# EasyEDA Pro project DartBLDC_Crtl(V2).eprj (continued)
## Notes on the sheets (continued)
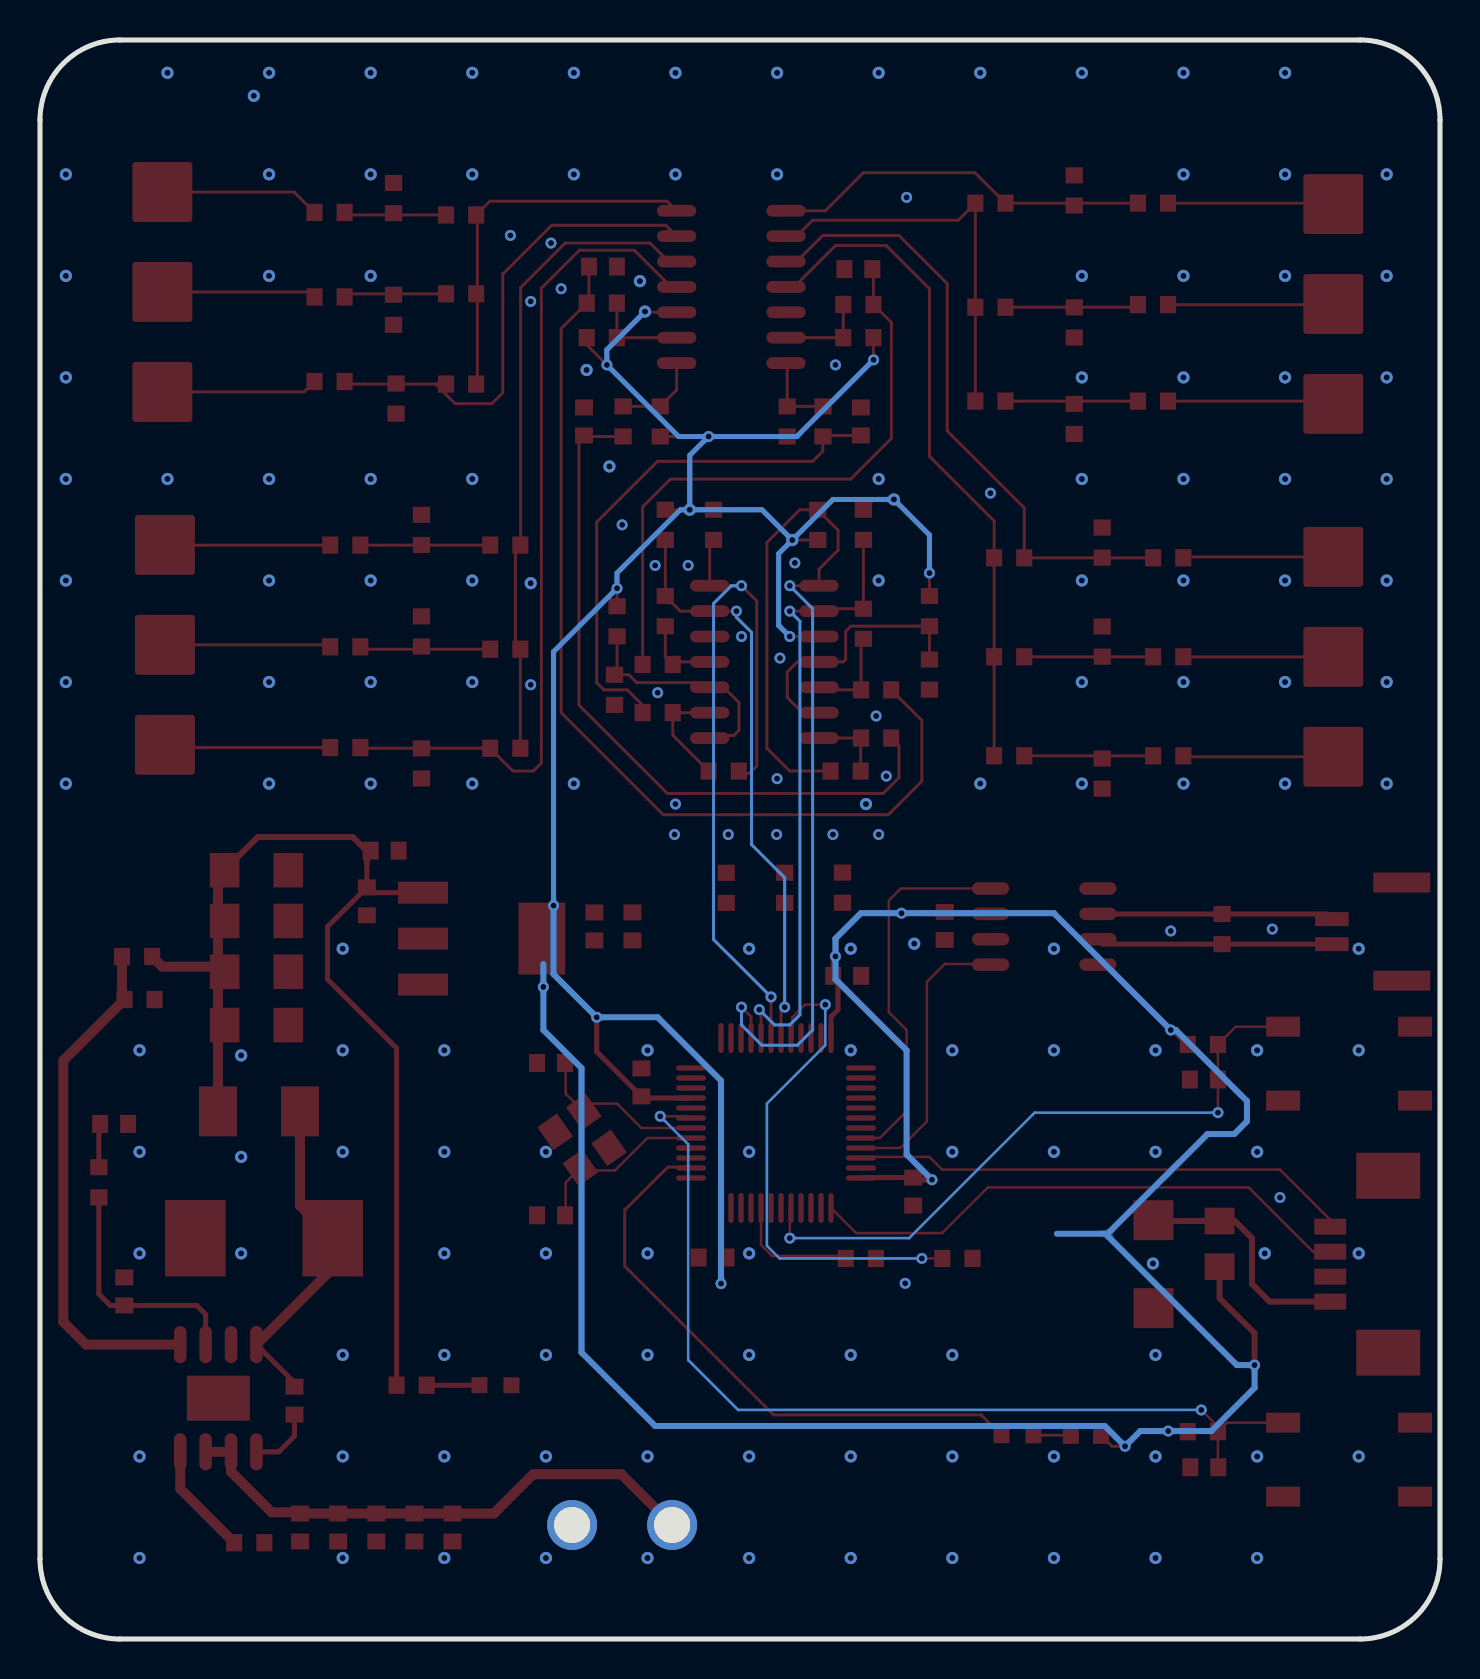
[diagram p4: board, bottom side, seen from below]

Outline 70 x 80 mm; copper layers: Top Layer, Bottom Layer. Coordinates in mm from the lower left corner of the outline.
Outline path: 0,76 0,4 arc(1.17,1.17) 4,0 66,0 arc(68.83,1.17) 70,4 70,76 arc(68.83,78.83) 66,80 4,80 arc(1.17,78.83) 0,76
Stack: Top Layer 0.035mm / Dielectric1 1.51mm FR4 er 4.5 / Bottom Layer 0.035mm

## Design rules (mm)
net OSCIN: DP1
net OSCOUT: DP1
template: 自定义配置
spacing copperThickness1oz (default): track to track 0.102, other pairs 0.152 to 0.3
spacing copperThickness2oz: track to track 0.203, other pairs 0.152 to 0.3
track width copperThickness1oz (default): min 0.127, default 0.254, max 2.54
track width copperThickness2oz: min 0.203, default 0.254, max 2.54
differential pair differentialPair (default): width min 0.127, default 0.254, max 2.54; gap min 0.152, default 0.152
via viaSize (default): diameter min 0.5, default 0.61, max 10; hole min 0.3, default 0.305, max 6.3
net GND uses copperRegion1
net GND_24V uses copperRegion1

## Placement (name value [footprint] x y rotation side)
3PHASE_INPUT1  WJ128V-5.0-3P  [CONN-TH_3P-P5.00_WJ128V-5.0-3P]  63.88 67.39 90 top
3PHASE_INPUT2  WJ128V-5.0-3P  [CONN-TH_3P-P5.00_WJ128V-5.0-3P]  63.75 49.74 90 top
3PHASE_INPUT3  WJ128V-5.0-3P  [CONN-TH_3P-P5.00_WJ128V-5.0-3P]  5.33 66.79 270 top
3PHASE_INPUT4  WJ128V-5.0-3P  [CONN-TH_3P-P5.00_WJ128V-5.0-3P]  5.33 49.14 270 top
C1  100nF  [C0603]  24.77 35.68 270 top
C2  100nF  [C0603]  11.8 27.99 0 top
C3  100nF  [C0603]  11.79 8.59 180 top
C4  22pF  [C0603]  44.45 21.2 180 top
C5  22pF  [C0603]  44.45 28.82 180 top
C6  100nF  [C0603]  36.37 19.08 180 top
C7  100nF  [C0603]  29.64 33.18 0 top
C8  100nF  [C0603]  26.34 22.39 90 top
C9  100nF  [C0603]  39.93 27.85 270 top
C10  100nF  [C0603]  28.96 60.91 270 top
C11  100nF  [C0603]  42.8 60.91 270 top
C12  100nF  [C0603]  41.85 68.66 0 top
C13  100nF  [C0603]  29.08 68.53 180 top
C14  100nF  [C0603]  57.28 11.93 270 top
C15  47uF  [C1206]  59.18 30.72 0 top
C16  47uF  [C1206]  59.18 33.38 0 top
C17  47uF  [C1206]  59.18 35.92 0 top
C18  4.7nF  [C0603]  49.38 5.58 90 top
C19  4.7nF  [C0603]  51.28 5.58 90 top
C20  4.7nF  [C0603]  53.19 5.58 90 top
C21  4.7nF  [C0603]  55.09 5.58 90 top
C22  100nF  [C0603]  57 5.58 90 top
C23  47uF  [C1206]  59.18 38.46 0 top
C24  22pF  [C0603]  65.79 17.39 270 top
C25  3.3nF  [C0603]  66.29 25.77 0 top
C26  10uF  [C0603]  40.38 35.65 270 top
C27  100nF  [C0603]  42.28 35.65 90 top
C28  100nF  [C0603]  53.66 36.9 270 top
C29  10uF  [C0603]  52.77 39.44 0 top
CN2  HC-GH-2PLT  [CONN-SMD_2P-P1.25_HCTL_HC-GH-2PLT]  3.66 35.39 270 top
CN4  XT30UPB-M  [CONN-TH_XT30UPB-M]  40.89 5.7 180 top
D1  SS34  [SMA_L4.3-W2.6-LS5.2-RD]  14.33 18.75 270 top
D2  B560C-13-F  [SMC_L7.1-W6.2-LS8.1-RD]  58.8 20.05 0 top
F1  BSMD0805-100-6V  [F0805]  11.02 19.77 90 top
KEY  -  [SW-SMD_4P-L5.1-W5.1-P3.70-LS6.5-TL-2]  4.55 28.79 0 top
L1  10uH  [IND-SMD_L5.4-W5.2]  59.05 26.4 180 top
LED1  19-213/Y2C-CQ2R2L/3T(CY)  [LED0603-RD-YELLOW]  21.13 10.19 180 top
PWR  -  [LED0603-RD]  47.23 12.7 0 top
R1  120Ω  [R0603]  10.9 35.52 270 top
R2  10kΩ  [R0603]  24.13 19.04 180 top
R3  1kΩ  [R0603]  17.7 10.19 180 top
R4  10kΩ  [R0603]  11.86 10.37 0 top
R6  10kΩ  [R0603]  11.86 29.74 0 top
R7  0Ω  [R0603]  35.69 37.58 270 top
R8  0Ω  [R0603]  32.77 37.58 270 top
R9  0Ω  [R0603]  29.87 37.59 270 top
R10  10kΩ  [R0603]  55.52 62.91 180 top
R11  1kΩ  [R0603]  48.94 62.79 180 top
R12  10kΩ  [R0603]  13.59 54.09 0 top
R13  1kΩ  [R0603]  21.54 54.09 0 top
R14  10kΩ  [R0603]  55.52 67.14 180 top
R15  1kΩ  [R0603]  48.94 67.3 180 top
R16  10kΩ  [R0603]  13.59 49.14 0 top
R17  1kΩ  [R0603]  21.54 49.14 0 top
R18  10kΩ  [R0603]  55.52 71.37 180 top
R19  1kΩ  [R0603]  48.94 71.25 180 top
R20  10kΩ  [R0603]  13.59 44.19 0 top
R21  1kΩ  [R0603]  21.54 44.19 0 top
R22  1kΩ  [R0603]  52.2 62.06 90 top
R23  1kΩ  [R0603]  52.32 66.5 90 top
R24  1kΩ  [R0603]  52.32 72.09 270 top
R25  1kΩ  [R0603]  16.89 54.85 270 top
R26  1kΩ  [R0603]  16.89 49.9 270 top
R27  1kΩ  [R0603]  16.89 43.3 90 top
R28  10kΩ  [R0603]  54.74 44.6 180 top
R29  1kΩ  [R0603]  46.74 44.57 180 top
R30  10kΩ  [R0603]  54.74 49.64 180 top
R31  1kΩ  [R0603]  46.74 49.52 180 top
R32  10kΩ  [R0603]  54.74 54.73 180 top
R33  1kΩ  [R0603]  46.74 54.73 180 top
R34  10kΩ  [R0603]  31.11 55.74 270 top
R35  10kΩ  [R0603]  28.83 55.74 90 top
R36  10kΩ  [R0603]  36.32 55.74 90 top
R37  10kΩ  [R0603]  38.73 55.74 90 top
R38  10kΩ  [R0603]  38.99 60.91 270 top
R39  10kΩ  [R0603]  41.91 65.11 0 top
R40  1kΩ  [R0603]  50.93 43.8 90 top
R41  1kΩ  [R0603]  50.93 50.41 270 top
R42  1kΩ  [R0603]  50.93 55.49 270 top
R43  470Ω  [R0603]  30.85 60.91 270 top
R44  1kΩ  [R0603]  41.15 50.92 90 top
R45  10kΩ  [R0603]  32.64 60.91 270 top
R46  10kΩ  [R0603]  29.08 65.11 180 top
R47  1kΩ  [R0603]  25.53 51.42 90 top
R48  470Ω  [R0603]  40.84 60.91 90 top
R49  10kΩ  [R0603]  28.19 47.49 0 top
R50  10kΩ  [R0603]  39.12 48.76 0 top
R51  1kΩ  [R0603]  41.27 47.49 90 top
R52  470Ω  [R0603]  41.91 66.83 180 top
R53  470Ω  [R0603]  29.08 66.77 180 top
R54  10kΩ  [R0603]  28.19 45.07 0 top
R55  10kΩ  [R0603]  39.12 46.34 0 top
R56  1kΩ  [R0603]  25.53 48.25 90 top
R57  100kΩ  [R0603]  29.72 43.42 0 top
R58  100kΩ  [R0603]  28.83 50.79 90 top
R59  100kΩ  [R0603]  35.81 43.42 180 top
R60  100kΩ  [R0603]  38.73 51.42 90 top
R61  10kΩ  [R0603]  14.35 71.84 0 top
R62  1kΩ  [R0603]  22.48 71.84 0 top
R63  10kΩ  [R0603]  14.35 66.76 0 top
R64  1kΩ  [R0603]  22.48 66.63 0 top
R65  10kΩ  [R0603]  14.35 61.93 0 top
R66  1kΩ  [R0603]  22.48 61.93 0 top
R67  1kΩ  [R0603]  18.29 72.47 270 top
R68  1kΩ  [R0603]  18.29 65.87 90 top
R69  1kΩ  [R0603]  18.29 61.04 90 top
R70  33.2kΩ  [R0603]  67.06 22.85 270 top
R71  1kΩ  [R0603]  51.42 12.7 180 top
R72  200kΩ  [R0603]  59.54 4.82 0 top
R73  53.6kΩ  [R0603]  65.15 34.15 180 top
R75  10.2kΩ  [R0603]  65.02 31.99 0 top
R76  10kΩ  [R0603]  28.96 19.04 0 top
RST  -  [SW-SMD_4P-L5.1-W5.1-P3.70-LS6.5-TL-2]  4.55 8.97 0 top
SWD  -  [CONN-SMD_4P-P1.25_53261-0471]  4.04 18.75 270 top
U1  STM32F103C8T6  [LQFP-48_L7.0-W7.0-P0.50-LS9.0-BL]  33.2 25.82 90 top
U2  SIT65HVD230DR  [SOP-8_L4.9-W3.9-P1.27-LS6.0-BL]  19.79 35.64 90 top
U3  LM339M/TR  [SOP-14_L8.6-W3.9-P1.27-LS6.0-BL]  33.78 48.88 270 top
U4  LM339M/TR  [SOP-14_L8.6-W3.9-P1.27-LS6.0-BL]  35.43 67.65 90 top
U5  SCT2650STER  [ESOP-8_L4.9-W3.9-P1.27-LS6.0-BL-EP-2]  61.08 12.05 0 top
U6  AMS1117-3.3  [SOT-223-3_L6.5-W3.4-P2.30-LS7.0-BR]  47.88 35.04 0 top
X1  12MHz  [OSC-SMD_4P-L3.2-W2.5-BL]  42.89 24.97 55 top

## Footprints (pads in the part's own frame, mm; a bottom-side part is the same pattern mirrored in y, then rotated)
C0603
  rect 0.8x0.9 smd: 1(-0.7,0) 2(0.7,0)
C1206
  rect 1.485x1.728 smd: 1(-1.593,0) 2(1.593,0)
CONN-SMD_2P-P1.25_HCTL_HC-GH-2PLT
  rect 0.7x1.68 smd: 1(-0.625,1.748) 2(0.625,1.748)
  rect 1x2.85 smd: 3(2.455,-1.748) 4(-2.455,-1.748)
CONN-SMD_4P-P1.25_53261-0471
  rect 0.8x1.6 smd: 1(-1.875,1.45) 2(-0.625,1.45) 3(0.625,1.45) 4(1.875,1.45)
  rect 2.3x3.2 smd: 5(4.425,-1.45) 6(-4.425,-1.45)
CONN-TH_3P-P5.00_WJ128V-5.0-3P
  rrect 3x3 smd: 1(-5,0) 2(0.003,0) 3(5,0)
CONN-TH_XT30UPB-M
  round 2.5 hole 1.8: 1(-2.5,0) 2(2.5,0)
ESOP-8_L4.9-W3.9-P1.27-LS6.0-BL-EP-2
  oval 0.63x1.865 smd: 1(-1.905,-2.683) 2(-0.635,-2.683) 3(0.635,-2.683) 4(1.905,-2.683) 5(1.905,2.683) 6(0.635,2.683) 7(-0.635,2.683) 8(-1.905,2.683)
  rect 3.15x2.26 smd: 9(0,0)
F0805
  rect 1.335x1.5 smd: 1(-1.143,0) 2(1.143,0)
IND-SMD_L5.4-W5.2
  rect 1.9x2.5 smd: 1(2.05,0) 2(-2.05,0)
LED0603-RD
  rect 0.8x0.8 smd: 1(-0.799,-0.004) 2(0.799,0.004)
LED0603-RD-YELLOW
  rect 0.8x0.8 smd: 1(-0.799,-0.004) 2(0.799,0.004)
LQFP-48_L7.0-W7.0-P0.50-LS9.0-BL
  oval 0.27x1.5 smd: 1(-2.75,-4.25) 2(-2.25,-4.25) 3(-1.75,-4.25) 4(-1.25,-4.25) 5(-0.75,-4.25) 6(-0.25,-4.25) 7(0.25,-4.25) 8(0.75,-4.25) 9(1.25,-4.25) 10(1.75,-4.25) 11(2.25,-4.25) 12(2.75,-4.25) 25(2.75,4.25) 26(2.25,4.25) 27(1.75,4.25) 28(1.25,4.25) 29(0.75,4.25) 30(0.25,4.25) 31(-0.25,4.25) 32(-0.75,4.25) 33(-1.25,4.25) 34(-1.75,4.25) 35(-2.25,4.25) 36(-2.75,4.25)
  oval 1.5x0.27 smd: 13(4.25,-2.75) 14(4.25,-2.25) 15(4.25,-1.75) 16(4.25,-1.25) 17(4.25,-0.75) 18(4.25,-0.25) 19(4.25,0.25) 20(4.25,0.75) 21(4.25,1.25) 22(4.25,1.75) 23(4.25,2.25) 24(4.25,2.75) 37(-4.25,2.75) 38(-4.25,2.25) 39(-4.25,1.75) 40(-4.25,1.25) 41(-4.25,0.75) 42(-4.25,0.25) 43(-4.25,-0.25) 44(-4.25,-0.75) 45(-4.25,-1.25) 46(-4.25,-1.75) 47(-4.25,-2.25) 48(-4.25,-2.75)
OSC-SMD_4P-L3.2-W2.5-BL
  rect 1.4x1.2 smd: 1(-1.1,-0.875) 2(1.1,-0.875) 3(1.1,0.875) 4(-1.1,0.875)
R0603
  rect 0.806x0.864 smd: 1(-0.753,0) 2(0.753,0)
SMA_L4.3-W2.6-LS5.2-RD
  rect 2x2 smd: 1(-2.2,0) 2(2.2,0)
SMC_L7.1-W6.2-LS8.1-RD
  rect 3.03x3.82 smd: 1(-3.435,0) 2(3.435,0)
SOP-8_L4.9-W3.9-P1.27-LS6.0-BL
  oval 0.63x1.865 smd: 1(-1.905,-2.683) 2(-0.635,-2.683) 3(0.635,-2.683) 4(1.905,-2.683) 5(1.905,2.683) 6(0.635,2.683) 7(-0.635,2.683) 8(-1.905,2.683)
SOP-14_L8.6-W3.9-P1.27-LS6.0-BL
  oval 0.595x1.968 smd: 1(-3.81,-2.734) 2(-2.54,-2.734) 3(-1.27,-2.734) 4(0,-2.734) 5(1.27,-2.734) 6(2.54,-2.734) 7(3.81,-2.734) 8(3.81,2.734) 9(2.54,2.734) 10(1.27,2.734) 11(0,2.734) 12(-1.27,2.734) 13(-2.54,2.734) 14(-3.81,2.734)
SOT-223-3_L6.5-W3.4-P2.30-LS7.0-BR
  rect 2.5x1.1 smd: 1(2.97,-2.3) 2(2.97,0) 3(2.97,2.3)
  rect 2.34x3.6 smd: 4(-2.97,0)
SW-SMD_4P-L5.1-W5.1-P3.70-LS6.5-TL-2
  rect 1.7x1 smd: 1(-3.3,1.85) 2(3.3,1.85) 3(-3.3,-1.85) 4(3.3,-1.85)

## Nets
As in the schematic, except:
GND: C1.2 C2.2 C3.1 C4.1 C5.1 C6.1 C7.1 C8.1 C9.1 C15.1 C16.1 C17.1 C18.1 C19.1 C20.1 C21.1 C22.1 C23.1 C24.1 C25.1 C26.2 C27.1 C28.2 C29.1 CN2.3 CN2.4 CN4.1 D1.2 D2.2 KEY.4 PWR.1 R2.2 R7.2 R8.2 R9.2 R72.1 R75.1 R76.1 RST.4 SWD.3 SWD.5 SWD.6 U1.8 U1.23 U1.35 U1.47 U2.2 U2.8 U5.7 U5.9 U6.1 X1.2 X1.4
NRST: C3.2 R4.1 RST.2 U1.7
PB5: C2.1 KEY.2 R6.1 U1.41
SWDCLK: SWD.2 U1.37
SWDIO: SWD.1 U1.34
$1N21300: D1.1 F1.2 SWD.4
$3N1105: PWR.2 R71.2

Pads without a net: KEY 1 3; RST 1 3; U1 1 3 4 10 11 12 13 14 15 21 22 25 26 27 28 29 30 31 38 39 40 42 43 45 46; U2 5

## Via types
v1: diameter 0.61, hole 0.304, Top Layer to Bottom Layer, 138 vias
v2: diameter 0.55, hole 0.3, Top Layer to Bottom Layer, 59 vias
v3: diameter 0.61, hole 0.305, Top Layer to Bottom Layer, 10 vias

## Routing (per net, layer and track width the routed paths; a pad name or vN(x,y) marks a point on that pad's centre or on a via; arc(x,y) is an arc through that point)
+5V: length 56.3
  Top Layer w0.254: C28.1 53.39,37.34 U6.3 ; C28.1 55.63,35.63 55.63,33.01 52.17,29.55 R71.1 ; C28.1 53.66,38.79 ; 53.66,39.25 C29.2
  Top Layer w0.3: 53.66,38.79 53.66,39.42 54.36,40.12 59.11,40.12 C23.2
  Top Layer w0.5: 61.1,33.38 61.1,33.64 ; 61.1,33.38 L1.2 ; 61.1,33.38 C16.2 ; 61.1,33.64 61.1,38.13 C23.2 ; 61.1,33.64 63.89,33.64 64.39,34.15
GND:
  vias: v1(4.06,34.53) v1(4.06,29.45) v1(4.06,19.29) v1(4.06,9.13) v1(8.76,19.29) v1(9.14,29.45) v1(9.14,24.37) v1(9.14,9.13) v1(9.14,4.05) v1(14.22,29.45) v1(14.22,24.37) v1(14.22,14.21) v1(14.22,9.13) v1(14.22,4.05) v1(14.35,18.79) v1(19.3,34.53) v1(19.3,29.45) v1(19.3,24.37) v1(19.3,9.13) v1(19.3,4.05) v1(24.38,29.45) v1(24.38,24.37) v1(24.38,14.21) v1(24.38,9.13) v1(24.38,4.05) v1(26.29,34.79) v1(29.46,34.53) v1(29.46,29.45) v1(29.46,14.21) v1(29.46,9.13) v1(29.46,4.05) v1(34.54,34.53) v1(34.54,24.37) v1(34.54,19.29) v1(34.54,14.21) v1(34.54,9.13) v1(34.54,4.05) v1(39.62,29.45) v1(39.62,19.29) v1(39.62,14.21) v1(39.62,9.13) v1(39.62,4.05) v1(44.7,24.37) v1(44.7,19.29) v1(44.7,14.21) v1(44.7,9.13) v1(44.7,4.05) v1(49.78,29.45) v1(49.78,24.37) v1(49.78,19.29) v1(49.78,14.21) v1(49.78,9.13) v1(49.78,4.05) v1(54.86,34.53) v1(54.86,29.45) v1(54.86,24.37) v1(54.86,14.21) v1(54.86,9.13) v1(54.86,4.05) v1(59.94,29.2) v1(59.94,24.12) v1(59.94,19.29) v1(65.02,29.45) v1(65.02,24.37) v1(65.02,19.29) v1(65.02,9.13) v1(65.02,4.05) v2(8,22.09) v2(8.39,35.52) v2(13.46,35.42) v2(26.74,17.8)
GND_24V:
  vias: v1(2.67,73.28) v1(2.67,68.2) v1(2.67,63.12) v1(2.67,58.04) v1(2.67,52.96) v1(2.67,47.88) v1(2.67,42.8) v1(7.75,78.36) v1(7.75,73.28) v1(7.75,68.2) v1(7.75,63.12) v1(7.75,58.04) v1(7.75,52.96) v1(7.75,47.88) v1(7.75,42.8) v1(12.83,78.36) v1(12.83,73.28) v1(12.83,68.2) v1(12.83,63.12) v1(12.83,58.04) v1(12.83,52.96) v1(12.83,47.88) v1(12.83,42.8) v1(17.91,78.36) v1(17.91,68.2) v1(17.91,63.12) v1(17.91,58.04) v1(17.91,52.96) v1(17.91,47.88) v1(17.91,42.8) v1(22.99,78.36) v1(22.99,42.8) v1(28.07,78.36) v1(28.07,58.04) v1(28.07,52.96) v1(33.15,78.36) v1(33.15,73.28) v1(38.23,78.36) v1(38.23,73.28) v1(43.31,78.36) v1(43.31,73.28) v1(43.31,42.8) v1(48.39,78.36) v1(48.39,73.28) v1(48.39,58.04) v1(48.39,52.96) v1(48.39,47.88) v1(48.39,42.8) v1(53.47,78.36) v1(53.47,73.28) v1(53.47,68.2) v1(53.47,58.04) v1(53.47,52.96) v1(53.47,47.88) v1(53.47,42.8) v1(58.55,78.36) v1(58.55,73.28) v1(58.55,68.2) v1(58.55,58.04) v1(58.55,52.96) v1(58.55,47.88) v1(58.55,42.8) v1(63.63,78.36) v1(63.63,58.04) v1(68.71,73.28) v1(68.71,68.2) v1(68.71,63.12) v1(68.71,58.04) v1(68.71,52.96) v1(68.71,47.88) v1(68.71,42.8) v2(22.48,57.33) v2(26.67,72.13) v2(27.69,43.17) v2(28.07,40.25) v2(28.19,46.18) v2(30.23,63.74) v2(30.35,40.25) v2(32.26,53.84) v2(33,49.08) v2(33.15,43.04) v2(33.17,40.25) v2(34.92,50.15) v2(35.59,40.25) v2(37.59,53.71) v2(38.23,41.77) v2(38.27,40.25) v2(39.12,47.34) v2(39.24,53.71) v2(40.89,55.74) v2(43.94,67.55) v2(44.45,69.84) v2(45.47,66.92) v2(45.47,47.74) v2(46.48,70.22) v3(28.7,41.77) v3(40.01,67.93) v3(41.53,58.66) v3(42.67,63.49) v3(45.47,52.82) v3(59.31,77.21)
VCC: length 270.5
  Top Layer w0.127: v2(13.59,10.4) 13.56,10.37 R4.2 ; v2(13.46,30.47) 12.74,29.74 R6.2
  Top Layer w0.15: v3(39.75,66.41) 39.72,66.38 U4.3 ; v2(32.51,50.15) 31.05,50.15 ; R46.2 28.33,64.01 v2(28.32,64) ; v3(27.3,57.01) 28.31,57.01 R35.2 ; R36.2 v3(37.51,56.5) R37.2 ; v3(32.39,54.98) 31.12,54.98 R34.2 ; v2(15.75,9.64) 16.4,9.64 R3.2 ; R45.2 v2(36.57,60.16) R38.2 ; v2(41.66,63.74) 42.66,64.75 R39.2 ; R47.2 25.53,53.2 ; v2(41.15,52.57) R44.2
  Top Layer w0.254: C6.2 35.95,19.36 U1.48 ; U1.9 39.85,27.07 C9.2 42.16,29.38 v2(42.16,31.1) 44.91,33.85 U6.4 ; v2(26.92,36.31) 25.66,36.31 25.63,36.34 25.56,36.28 U2.3 ; U1.36 28.93,23.09 C8.2 ; v2(30.23,34.15) 30.34,34.04 C7.2 30.1,32.94 30.1,31.49 30.45,31.14 U1.24
  Top Layer w0.3: v2(25.4,22.98) 26.23,22.98 C8.2 ; v2(9.27,13.71) 9.27,15.3 11.02,17.05 F1.1 ; C6.2 35.95,18.81 v2(35.95,17.78)
  Bottom Layer w0.15: v2(41.15,52.57) 41.15,52.86
  Bottom Layer w0.254: v3(37.51,56.5) 37.98,56.5 41.15,53.33 41.15,52.86 ; v3(37.51,56.5) 37.51,59.22 v2(36.57,60.16) ; v3(37.51,56.5) 33.9,56.5 v3(32.39,54.98) ; v3(32.39,54.98) 33.07,54.3 33.07,50.71 v2(32.51,50.15) ; v3(32.39,54.98) 30.35,57.01 v3(27.3,57.01) 25.53,55.23 v2(25.53,53.33) ; v2(28.32,64) 32.16,60.16 v2(36.57,60.16) ; v2(44.32,36.69) 44.32,49.39 v2(41.15,52.57) ; v2(36.57,60.16) 38.07,60.16 v2(41.66,63.74) 41.66,64.51 v3(39.75,66.41)
  Bottom Layer w0.3: v2(25.4,22.98) 26.67,24.25 26.67,29.45 30.23,33.01 v2(30.23,34.15) 30.23,35.04 28.96,36.31 v2(26.92,36.31) 19.3,36.31 v2(13.46,30.47) 13.21,30.47 9.65,26.91 9.65,25.9 10.29,25.26 11.63,25.26 16.61,20.28 ; v2(35.95,17.78) 35.95,27.94 39.12,31.1 v2(42.16,31.1) 44.32,33.26 v2(44.32,36.69) ; 16.61,20.28 19.15,20.28 ; 16.61,20.28 16.61,20.16 10.16,13.71 v2(9.27,13.71) 9.27,12.56 11.43,10.4 v2(13.59,10.4) 14.99,10.4 v2(15.75,9.64) 16.76,10.66 39.24,10.66 42.93,14.34 42.93,28.56 44.83,30.47 v2(44.83,32.62) 44.83,33.77
A1: length 25
  Top Layer w0.15: U4.6 38.71,70.73 44.42,70.73 46.86,68.28 46.86,62.35 47.41,61.8 49.24,61.8 50.22,62.79 ; 50.22,62.79 54.64,62.79 R10.2 ; 50.22,62.79 R11.1
A2: length 41.8
  Top Layer w0.15: R28.2 53.95,44.57 R29.1 47.49,44.56 46.36,43.42 45.34,43.42 44.93,43.83 44.93,67.58 43.03,69.48 40.28,69.48 38.45,67.65 U4.4
A3: length 19
  Top Layer w0.15: U4.8 30.73,71.46 28.83,73.36 23.25,73.36 R62.1 R61.2
A4: length 31.4
  Top Layer w0.15: 32.7,68.92 32.17,68.92 30.86,70.22 27.05,70.22 24.64,67.81 24.64,60.44 20.79,56.59 R13.1 R12.2
CANRX: length 19.1
  Top Layer w0.127: U2.4 26.96,37.55 27.56,36.95 27.56,31.36 26.67,30.47 26.67,26.41 28.01,25.07 U1.32
CANTX: length 14.4
  Top Layer w0.127: U1.33 26.99,24.57 25.65,25.9 25.65,32.88 24.77,33.77 22.5,33.77 U2.1
LED: length 29.4
  Top Layer w0.15: LED1.1 22.95,11.21 33.32,11.21 40.77,18.66 40.77,21.45 38.61,23.61 37.5,23.61 U1.2
N1: length 18.9
  Top Layer w0.15: 48.13,62.79 48.13,71.31 47.51,71.93 38.64,71.93 U4.7
N2: length 32.4
  Top Layer w0.15: 38.17,68.92 38.57,68.92 39.5,69.84 43.74,69.84 45.97,67.61 45.97,54.74 R33.2 46.23,54.48 46.23,49.77 R31.2 R29.2
N3: length 20.1
  Top Layer w0.15: R66.2 R64.2 R62.2 24.09,70.98 31.37,70.98 32.17,70.19 U4.9
N4: length 33.6
  Top Layer w0.15: R21.2 R17.2 R13.2 22.29,55.94 25.53,59.17 25.53,67.55 27.69,69.71 30.23,69.71 32.29,67.65 U4.11
NRST: length 47.7
  Top Layer w0.127: 11.1,10.37 11.1,8.61 C3.2 ; 11.1,10.37 10.65,10.82 RST.2 ; 11.1,10.37 11.1,10.63 v2(11.94,11.46) ; v2(38.99,26.15) 37.54,26.15 U1.7
  Bottom Layer w0.127: v2(11.94,11.46) 35.09,11.46 37.59,13.96 37.59,24.75 v2(38.99,26.15)
O1: length 35.9
  Top Layer w0.15: R48.1 42.75,60.16 C11.2 43.05,59.96 43.05,46.73 38.63,42.31 27.84,42.31 27.05,43.09 27.05,44.69 R54.1
O2: length 48.9
  Top Layer w0.15: R49.1 25.91,45.96 25.91,42.92 27.58,41.24 38.84,41.24 43.94,46.34 43.94,65.55 R52.1 42.55,66.94 C12.2
O3: length 26.6
  Top Layer w0.15: R55.2 39.87,46.72 40.64,47.49 41.81,47.49 42.16,47.85 42.16,55.88 39.13,58.92 31.37,58.92 30.86,59.43 30.86,60.15 R43.2 30.8,60.21 C10.2
O4: length 30.6
  Top Layer w0.15: R50.2 39.87,56.64 38.48,58.03 29.46,58.03 27.43,60.06 27.43,65.87 R53.2 28.33,68.48 C13.2
OSCIN: length 8.9
  Top Layer w0.127: U1.5 39.63,25.07 41.25,23.44 42.85,23.44 X1.1 43.72,22.83 43.72,21.23 C4.2
OSCOUT: length 8.8
  Top Layer w0.127: 43.75,28.69 43.72,28.69 43.72,27.29 X1.3 42.4,26.79 41.15,26.79 39.93,25.57 U1.6
PB5: length 32.6
  Top Layer w0.127: v2(11.1,26.33) C2.1 11.1,27.99 11.1,29.74 10.21,30.64 KEY.2 ; U1.41 32.51,21.5 v2(32.51,20.06)
  Bottom Layer w0.127: v2(32.51,20.06) 26.54,20.06 20.27,26.33 v2(11.1,26.33)
SWDCLK: length 27.8
  Top Layer w0.127: SWD.2 6.35,19.38 9.57,22.6 22.61,22.6 24.89,20.31 29.19,20.31 U1.37
SWDIO: length 25.1
  Top Layer w0.127: SWD.1 5.49,20.97 8,23.48 24.89,23.48 25.53,24.12 28.89,24.12 U1.34
TIM3_CH1: length 52.9
  Top Layer w0.15: v2(34.92,31.61) 34.45,31.14 U1.16 ; R57.2 32.51,43.42 33.66,44.57 33.66,54.85 32.01,56.5 R34.1 30.1,55.48 30.1,54.47 31.05,53.52 31.05,52.69 v2(32.51,52.69)
  Bottom Layer w0.15: v2(32.51,52.69) 31.37,51.55 31.37,30.47 32.13,29.71 33.91,29.71 34.92,30.72 v2(34.92,31.61)
TIM3_CH2: length 31.6
  Top Layer w0.15: v2(32.51,51.42) 31.05,51.42 30.93,51.54 R58.2 R35.1 ; v2(34.04,31.49) 33.95,31.4 U1.17
  Bottom Layer w0.15: v2(32.51,51.42) 32,50.92 32,31.23 32.51,30.72 33.27,30.72 v2(34.04,31.49)
TIM3_CH3: length 39.1
  Top Layer w0.15: v2(33.45,32.12) U1.18 ; R36.1 36.52,54.8 U3.14 v2(34.92,52.69) 34.16,51.93 34.16,43.68 34.54,43.31 34.94,43.31 R59.2
  Bottom Layer w0.15: v2(33.45,32.12) 36.32,34.99 36.32,51.81 35.43,52.69 v2(34.92,52.69)
TIM3_CH4: length 29.1
  Top Layer w0.15: v2(35.18,51.42) U3.13 37.98,51.42 R60.2 R37.1 ; 32.77,31.61 32.95,31.43 U1.19
  Bottom Layer w0.15: v2(35.18,51.42) 35.18,51.12 34.42,50.36 34.42,39.75 32.77,38.09 v2(32.77,31.61)
$1N16466: length 11.8
  Top Layer w0.254: CN2.2 10.9,34.77 ; U2.7 16.86,34.76 R1.2
$1N16467: length 11.8
  Top Layer w0.254: CN2.1 5.66,36.27 R1.1 17.1,36.27 U2.6
$1N16528: length 25.2
  Top Layer w0.127: v2(30.73,31.74) 31.75,31.74 32.39,31.1 32.39,30.13 U1.20 ; v2(25.91,19.04) R2.1
  Bottom Layer w0.127: v2(25.91,19.04) 33.02,19.04 33.66,19.67 33.66,26.79 30.73,29.71 30.73,31.61
$1N16562: length 6.4
  Top Layer w0.127: U1.44 33.95,19.71 33.4,19.17 29.84,19.17 R76.2
$1N21300: length 11.9
  Top Layer w0.3: D1.1 14.28,20.91 F1.2 10.25,20.91 9.4,20.06 9.4,17.76 8.51,16.88 SWD.4
$1N22506: length 1.9
  Top Layer w0.15: R3.1 20.33,10.19 LED1.2
$2N466: length 7.8
  Top Layer w0.15: R10.1 56.8,62.39 3PHASE_INPUT1.1
$2N467: length 7.7
  Top Layer w0.15: R14.1 56.53,67.39 3PHASE_INPUT1.2
$2N468: length 8
  Top Layer w0.15: 3PHASE_INPUT1.3 57.29,72.39 R18.1
$2N470: length 5.1
  Top Layer w0.15: R15.1 54.61,67.3 R14.2
$2N471: length 5.1
  Top Layer w0.15: R18.2 54.64,71.25 R19.1
$2N1458: length 8.3
  Top Layer w0.15: R28.1 63.61,44.6 3PHASE_INPUT2.1
$2N1459: length 8.3
  Top Layer w0.15: R30.1 55.59,49.74 3PHASE_INPUT2.2
$2N1460: length 8.3
  Top Layer w0.15: 3PHASE_INPUT2.3 63.74,54.73 R32.1
$2N1462: length 6.5
  Top Layer w0.15: R30.2 53.86,49.52 R31.1
$2N1463: length 6.5
  Top Layer w0.15: R33.1 R32.2
$2N1768: length 8.3
  Top Layer w0.15: R61.1 5.38,71.84 3PHASE_INPUT3.1
$2N1769: length 8.3
  Top Layer w0.15: 3PHASE_INPUT3.2 5.37,66.76 R63.1
$2N1770: length 8.3
  Top Layer w0.15: R65.1 5.47,61.93 3PHASE_INPUT3.3
$2N1772: length 6.7
  Top Layer w0.15: R64.1 15.23,66.63 R63.2
$2N1773: length 6.6
  Top Layer w0.15: R66.1 R65.2
$2N3010: length 4
  Top Layer w0.15: R43.1 R45.1 32.64,63.78 U4.14
$2N3045: length 4.4
  Top Layer w0.15: U4.1 38.17,62.49 R38.1 R48.2
$2N3701: length 7.5
  Top Layer w0.15: R12.1 12.79,54.14 3PHASE_INPUT4.1
$2N3702: length 7.5
  Top Layer w0.15: 3PHASE_INPUT4.2 12.83,49.14 R16.1
$2N3703: length 7.5
  Top Layer w0.15: R20.1 12.79,44.14 3PHASE_INPUT4.3
$2N3710: length 6.4
  Top Layer w0.15: R16.2 R17.1
$2N3711: length 6.4
  Top Layer w0.15: R20.2 R21.1
$2N5185: length 13.7
  Top Layer w0.15: R56.2 R47.1 29.46,50.67 29.72,50.41 29.72,49.01 29.85,48.88 32.13,48.88 32.64,48.38 32.64,47.11 31.88,46.34 31.05,46.34
$2N5288: length 11.8
  Top Layer w0.15: R44.1 41.15,48.37 R51.2 40.56,48.24 40.16,47.85 36.75,47.85 U3.10 35.81,47.61 35.05,46.85 35.05,45.46 35.31,45.2 36.39,45.2 U3.8
$2N6019: length 4.5
  Top Layer w0.15: R53.1 R46.1 U4.13
$2N6049: length 4.7
  Top Layer w0.15: U4.2 R39.1 R52.2
$2N6453: length 3.8
  Top Layer w0.15: 31.05,45.07 R54.2 28.96,45.06 R57.1
$2N6465: length 4.8
  Top Layer w0.15: R58.1 28.95,49.92 R49.2 30.92,47.49 31.05,47.61
$2N6474: length 5.5
  Top Layer w0.15: R59.1 38.36,45.22 R55.1 U3.9
$2N6485: length 4
  Top Layer w0.15: R60.1 38.73,49.13 R50.1 38.24,48.88 U3.11
$3N1089: length 2.2
  Top Layer w0.254: C25.2 67.06,25.71 R70.1
$3N1090: length 5.7
  Top Layer w0.5: U5.4 62.99,7.52 R72.2
$3N1091: length 27.1
  Top Layer w0.5: U5.3 U5.2 60.45,8.37 58.42,6.34 57.06,6.34 C22.2 C21.2 C20.2 C19.2 C18.2 47.3,6.28 45.34,8.25 40.93,8.25 CN4.2
$3N1093: length 16.8
  Top Layer w0.254: U5.8 57.28,12.83 C14.1
  Top Layer w0.5: L1.1 57,21.69 D2.1 55.36,18.55 U5.8
$3N1098: length 12.1
  Top Layer w0.254: R70.2 67.06,17.26 66.49,16.69 C24.2 62.17,16.69 61.72,16.25 61.72,14.73 U5.6
$3N1100: length 25.9
  Top Layer w0.5: U5.5 67.7,14.73 68.83,15.86 68.83,28.94 R75.2 65.9,32.12 R73.1
$3N1105: length 2.6
  Top Layer w0.254: PWR.2 48.03,12.7 R71.2
$3N1107: length 3.3
  Top Layer w0.254: U5.1 58.06,9.36 57.28,10.15 C14.2

## Copper pours and planes (outline as drawn; the poured copper is in the pictures)
GND on Top Layer: 27.84,37.43 25.27,39.99 0.13,39.99 -1.27,38.6 -1.27,1.26 2.16,-2.17 68.96,-2.17 72.39,1.26 72.39,37.2 68.58,41.01 42.16,41.01 38.58,37.43
GND on Bottom Layer: -1.02,38.56 70,38.56 70,-1.03 -1.02,-1.03
GND_24V on Top Layer: 26.67,43.04 29.58,40.13 39.12,40.13 43.05,44.06 69.7,44.06 72.39,46.75 72.39,81.4 69.22,84.57 2.54,84.57 -1.14,80.89 -1.14,46.09 1.91,43.04
GND_24V on Bottom Layer: -0.76,81.14 71.12,81.14 71.12,39.23 -0.76,39.23
VCC on Top Layer: 39.24,37.41 52.7,37.41 52.7,32.88 39.24,32.88

Small or netless copper shapes (teardrops, artwork), in the pictures only: 382 on Top Layer, 55 on Bottom Layer

## Text on the board
Top Silkscreen Layer: CLK | IO | G | V | L | H | 24.3.26 | 2.0 | 24V | 飞镖测速板
